# EasyEDA Pro project Zero_PCB_JLCEDA.eprj, board Zero_PCB (continued)
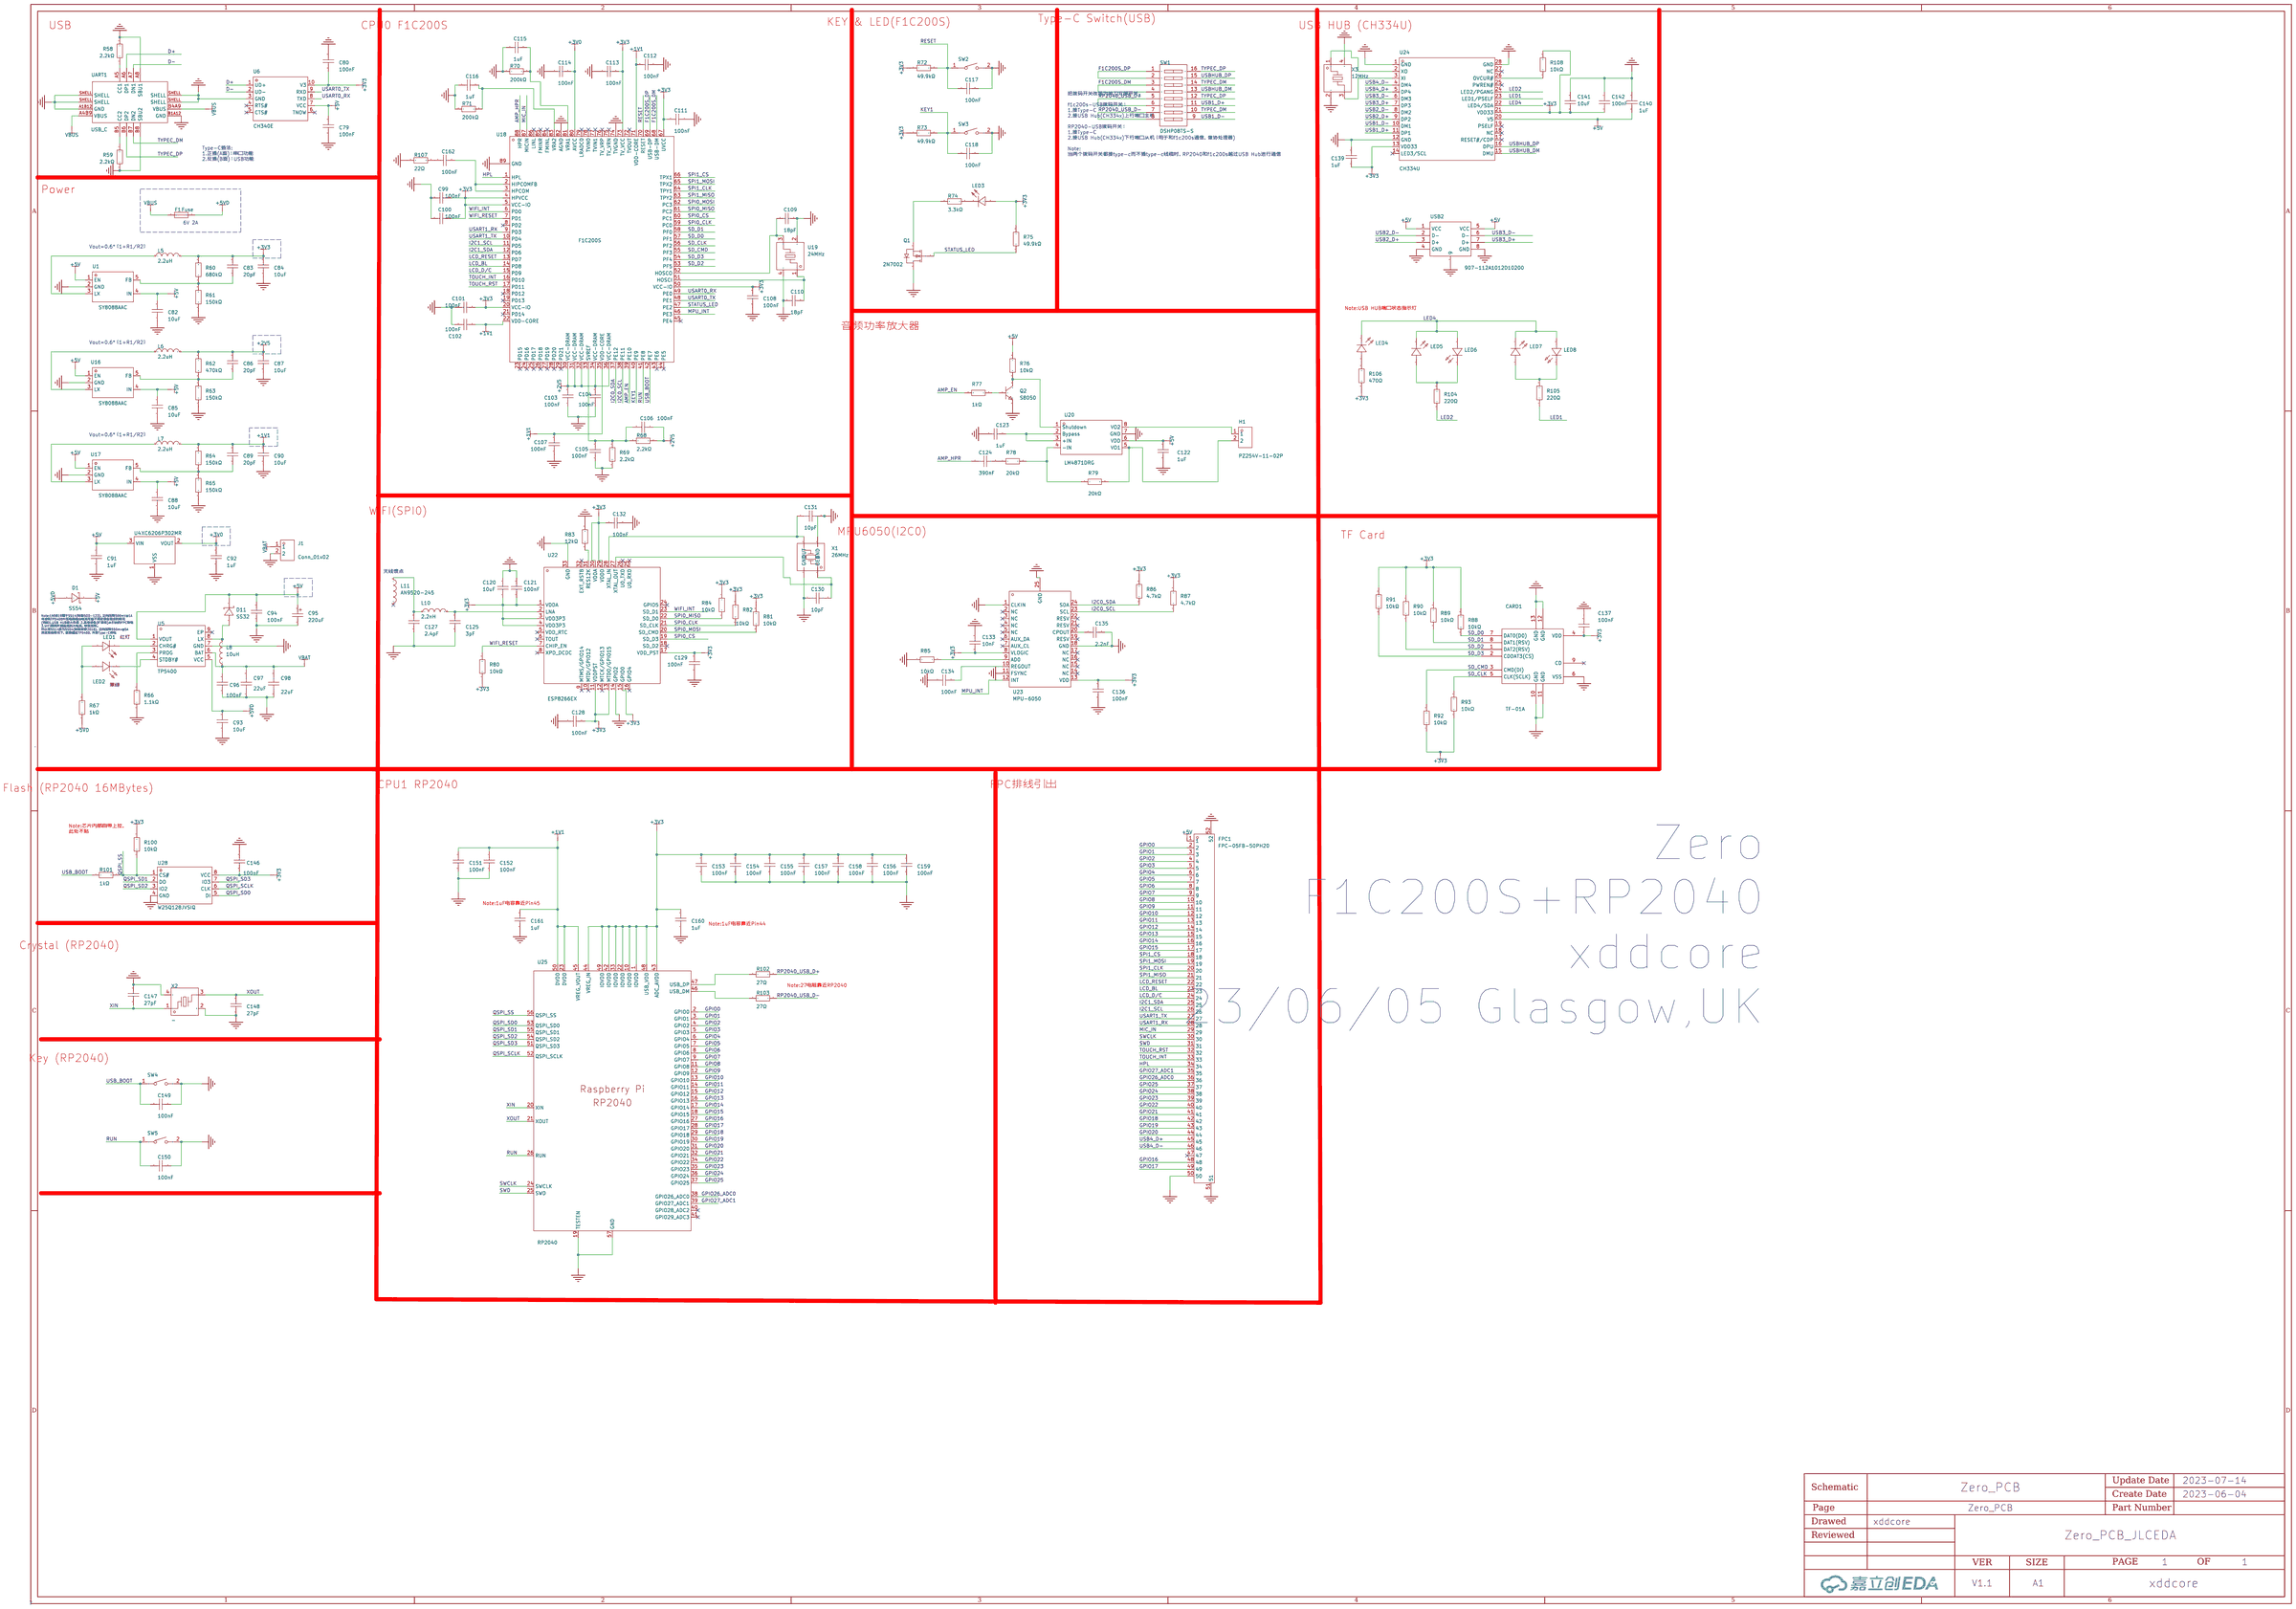
[diagram p0: schematic sheet]
## Routing (per net, layer and track width the routed paths; a pad name or vN(x,y) marks a point on that pad's centre or on a via; arc(x,y) is an arc through that point) (continued)
  Top Layer w0.254: 1.4,35.15 1.66,35.41 2.12,35.41 ; 1.4,35.15 1.4,36 1.43,36.02 1.43,36.24 1.25,36.42 ; 1.4,35.15 1.29,35.04 1.29,32.06 v1(1.81,31.54) 1.82,31.52 2.93,32.63 2.93,34.23 ; 7.24,36.89 7.25,36.9 7.25,37.38 ; C158.1 v1(11.36,23.64) ; v1(18.18,21.98) 18.18,21.98 18.15,21.96 ; 40.39,20.01 40.87,20.5 40.87,21.77 ; 42.11,35.07 42.11,36.38 42.17,36.44 ; 42.11,35.07 42.16,35.03 43.28,35.03 ; 42.11,35.07 42.11,35.03 ; 42.11,35.07 42.1,35.08 ; 6.67,31.73 6.65,31.75 4.1,31.75 ; 3.97,20.14 3.96,20.15 3.59,20.15 ; 18.98,19.54 19.55,18.96 19.55,17.46 19.22,17.12 18.93,17.12 ; 18.98,19.54 18.98,19.52 ; 18.98,19.54 18.91,19.6 ; 18.98,19.54 18.98,19.63 ; 11.35,21.11 9.72,21.11 9.7,21.1 ; 11.35,21.11 11.37,21.11 ; 11.35,21.11 12.22,21.98 v1(13.98,21.98) ; 11.35,21.11 11.34,21.11 ; v1(5.99,26.27) 5.99,27.26 U25.22 ; v1(28.46,43.93) 28.46,43.15 ; 5.61,20.14 5.61,18.81 6.07,18.34 ; 5.61,20.14 5.61,20.27 ; 5.61,20.14 5.59,20.14 ; 5.61,20.14 5.97,20.14 ; 16.37,6.67 17.23,6.67 17.25,6.65 ; 5.42,39.21 5.42,39.22 4.94,39.22 ; 47.47,30.04 47.09,29.65 46.49,29.65 ; 18.15,21.96 18.98,21.13 18.98,19.63 ; 18.15,21.96 17.76,22.35 L5.2 ; 3.57,20.2 2.66,21.11 2.66,21.11 ; 3.57,18.38 3.59,18.4 3.59,20.15 ; 4.94,39.22 4.94,39.15 ; 4.94,39.22 4.92,39.22 ; 4.94,39.22 v1(4.94,39.97) 4.94,40.32 5.12,40.5 ; 3.59,20.15 3.59,20.18 ; 3.59,20.15 3.58,20.15 ; 2.64,24.72 v1(1.7,24.72) 1.16,24.72 ; 48.89,40.59 47.51,40.59 47.49,40.6 ; 7.31,18.36 6.07,18.36 ; 43.6,28.94 v1(43.6,28.11) 43.14,27.65 ; v1(49.15,44.09) 49.46,43.78 49.46,41.24 48.84,40.62 ; 5.29,28.98 5.99,28.27 5.99,27.33 ; v1(15.19,9.42) 14.9,9.14 14.9,7.09 15.42,6.57 16.32,6.57 ; C101.1 26.62,38.14 26.62,40.04 C100.2 ; 47.68,30.1 47.68,30.72 v1(47.42,30.98) ; 47.62,30.05 48.11,30.05 48.5,29.66 48.5,25.83 47.99,25.31 ; U28.8 4.27,11.7 4.31,11.7 ; 18.98,19.63 18.97,19.64 v1(17.96,19.64) ; 18.98,19.63 19,19.61 ; 40.86,45.9 40.46,46.3 C111.2 ; 40.86,45.9 R72.1 ; 40.86,45.9 40.86,45.88 v1(40.52,45.53) ; 2.66,21.11 1.11,21.11 ; 1.11,21.11 C154.1 ; 1.11,21.11 1.54,20.68 1.54,12.53 C146.1 ; 1.11,21.11 1.09,21.11 ; C154.1 1.7,21.73 1.7,24.13 C155.1 ; C154.1 1.08,21.14 ; 2.22,11.81 2.32,11.71 4.31,11.7 ; v2(29.7,18.61) 31.2,18.61 31.2,18.61 ; 7.35,37.39 v1(8.02,37.39) 8.62,37.39 8.96,37.74 ; 13.29,12.59 13.29,13.2 v1(13,13.49) ; 37.7,27.01 37.7,26.96 ; 37.7,27.01 37.7,28.04 ; 37.7,27.01 37.72,25.8 39.95,23.57 40.34,23.57 40.87,23.04 40.87,22.32 ; 28.48,43.13 28.46,43.15 28.5,41.94 28.53,41.91 ; 1.25,36.42 2.13,36.42 ; 1.25,36.42 0.84,36.83 1.1,37.09 1.1,40.4 2.14,41.45 R80.1 2.62,41.42 v1(3.19,41.42) ; 0.94,36.79 1.56,37.4 2.18,37.4 ; 48.92,40.58 48.89,40.56 v1(48.89,39.79) ; 6.88,40.53 6.44,40.09 v1(6.44,39.89) 6.44,39.2 ; 37.7,28.04 v1(37.68,28.06) 35.1,28.06 35.02,28.14 35.02,28.57 34.96,28.64 ; 37.7,28.04 37.7,28.55 37.55,28.7 ; 4.09,31.72 3.72,31.72 2.98,32.45 ; 40.5,19.99 41.23,19.99 v1(41.39,20.14) ; 4.31,11.7 v1(6.49,11.7) ; 11.36,24.73 9.74,24.73
  In2.Cu w0.254: 29.95,21.23 28.87,21.23 17.51,9.87 16.44,9.87 16,9.42 15.19,9.42 ; 29.95,21.23 40.3,21.23 v1(41.39,20.14) ; 29.95,21.23 v2(29.95,20.75) ; v1(5.61,19.3) 8.84,19.3 v1(9.29,19.75) 9.29,20.06 9.98,20.75 12.74,20.75 v1(13.98,21.98) ; v1(6.49,11.7) 7.89,11.7 8.4,12.21 11.72,12.21 v1(13,13.49) 13,13.48 13.24,13.24 13.24,11.05 14.87,9.42 15.19,9.42 ; v1(11.36,23.64) 8.98,23.64 8.73,23.89 8.37,23.89 v1(5.99,26.27) ; v1(28.46,43.93) 28.48,43.95 28.48,45.22 29.28,46.03 32.83,46.03 33.08,45.77 34.73,45.77 36.71,47.75 40.18,47.75 v1(42.37,45.56) 48.38,45.56 v1(49.15,46.34) ; v1(8.02,37.39) 8.02,38.32 v1(6.44,39.89) 6.36,39.97 v1(4.94,39.97) 4.63,39.97 v1(3.19,41.42)
  Bottom Layer w0.127: v1(36.99,45.38) 36.97,45.38 37.28,45.07 39.65,45.07 39.65,44.94 40.35,44.23 41.69,44.23 42.37,44.91 42.37,45.56 v1(42.37,45.56)
  Bottom Layer w0.254: 8.92,18.67 9.17,18.92 9.17,19.47 9.29,19.59 v1(9.29,19.75) ; 47.26,35.29 47.26,31.47 47.24,31.46 47.24,31.16 v1(47.42,30.98) 47.42,28.74 46.8,28.13 43.6,28.13 43.6,28.11 ; 47.26,35.29 48.88,36.91 48.88,39.78 v1(48.89,39.79) ; 47.26,35.29 v1(43.98,35.29) ; 17.48,18.63 16.19,18.63 ; 16.19,18.63 16.18,18.62 ; 16.19,18.63 16.16,18.66 14.21,18.66 ; 16.19,18.63 16.2,18.62 ; 1.8,31.58 1.81,31.57 v1(1.81,31.54) 1.14,30.87 1.14,27.36 1.7,26.8 v1(1.7,24.72) ; v1(42.37,45.56) 40.55,45.56 v1(40.52,45.53) ; 11.7,18.61 11.68,18.62 10.3,18.62 ; v2(29.95,20.75) 29.95,18.86 v2(29.7,18.61) ; 12.89,17.89 12.19,18.6 11.72,18.6 ; v1(43.6,28.11) 43.56,28.07 37.71,28.07 37.7,28.06 v1(37.68,28.06) ; 14.17,18.6 13.76,18.6 13.18,18.02 12.91,18.02 ; 17.49,18.63 17.49,19.17 v1(17.96,19.64) ; 12.61,15.97 12.61,17.52 12.91,17.82 ; v1(18.18,21.98) v1(13.98,21.98) 12.75,21.98 11.36,23.38 v1(11.36,23.64) ; 5.62,19.31 5.61,19.3 v1(5.61,19.3) ; v1(49.15,44.09) v1(49.15,46.34) ; v1(13,13.49) 12.65,13.84 12.65,15.72
+5V: length 53.6
  Top Layer w0.127: v1(20.51,24.71) 21.13,24.09 21.53,24.09 21.94,23.68 v1(21.94,23.6)
  Top Layer w0.254: 17.68,14.75 17.74,14.81 ; 17.68,14.75 17.68,14.61 18.15,14.14 19.9,14.14 21.05,15.29 ; 17.68,14.75 17.64,14.7 16.37,14.7 ; 17.68,14.75 17.68,14.87 ; 24.16,11.36 24.16,11.56 23.53,12.19 ; v1(23.87,42.46) 24.09,42.46 24.58,41.97 ; 18.75,7.27 18.75,7.53 17.91,8.36 ; v1(21.94,23.6) 22.78,23.6 23.88,24.69 ; v1(17.09,8.61) 17.77,8.61 17.86,8.52 ; v1(20.51,24.71) 19.58,24.71 ; 23.05,30.92 23.05,32.35 ; 23.05,32.35 23.03,32.33 ; 23.05,32.35 23.05,34.36 ; 27.9,27.56 26.87,27.56 v1(26.08,28.35) 25.18,29.26 25.18,29.44 ; 38.33,26.97 38.33,28.18 38.81,28.66 ; 19.74,23.58 19.74,24.51 19.52,24.74 ; 21.12,17.35 21.17,17.3 21.17,15.46 ; 22.97,34.39 23.04,34.46 23.04,36.6 24.88,38.44 24.88,41.22 24.61,41.48 24.61,41.93 ; 23.5,12.44 23.5,13.13 v1(22.8,13.83) 21.17,15.46 ; 21.17,15.46 21.17,15.07 ; 21.17,15.46 20.97,15.66 ; 15.43,18.19 15.43,17.4 15.17,17.14 ; 17.37,21.11 17.37,20.62 v1(16.44,19.69) 15.51,18.76 15.51,18.5 ; 23.94,29.97 24.61,29.97 25.16,29.42 ; v1(19.6,26.21) 20.04,26.65 21.3,26.65 21.48,26.82 21.48,27.38 ; 23.8,30.21 23.09,30.92 ; 38.97,28.66 v1(38.97,29.45)
  Bottom Layer w0.254: v1(19.6,26.21) 19.6,25.62 v1(20.51,24.71) ; 28.58,31.2 29.05,31.2 v1(29.25,30.99)
+5VD: length 25.6
  Top Layer w0.254: 27.3,19.61 27.37,19.54 27.37,18.31 ; 30.74,9.98 31.18,9.98 v1(31.3,10.1) ; 18.27,13 21.09,10.17 ; 27.37,18.31 28.14,18.31 v1(28.31,18.13) ; 27.37,18.31 27.37,18.13 ; 27.37,18.31 27.31,18.31 ; 21.13,10.5 v1(21.13,11.93)
  In2.Cu w0.254: v1(21.13,11.93) 27.16,11.93 28.31,13.09 ; v1(28.31,18.13) 28.31,13.09 ; 28.31,13.09 v1(31.3,10.1)
GND: length 254.5
  Top Layer w0.254: 16.27,7.65 15.67,8.25 v1(15.67,8.72) ; 45.43,31.93 45.64,32.15 46.35,32.15 ; 43,26.41 42.19,27.22 42.19,27.77 41.27,28.69 40,28.69 ; 39.37,47.36 36.96,47.36 36.9,47.41 ; 28.28,8.12 28.23,8.07 ; 28.28,8.12 28.53,8.37 28.53,9.88 ; 28.28,8.12 28.22,8.12 ; 28.28,8.12 28.76,8.12 29.28,7.6 ; v1(23.96,36.22) 24.27,35.91 24.31,35.91 ; 44.9,36.38 44.71,36.19 44.71,34.51 ; 44.9,36.38 44.94,36.42 ; 44.9,36.38 44.89,36.39 43.26,36.39 ; 22.83,28.86 23.1,28.59 v1(23.1,28.14) 23.1,27.41 ; 7.77,30.04 7.74,30.01 4,30.01 ; 7.77,30.04 7.79,30.06 ; 7.77,30.04 9.05,30.04 9.59,30.57 ; UART1.A8 26.28,8.8 25.54,9.54 25.54,9.87 R66.1 ; 33.52,15.41 35.23,17.13 35.23,18.15 35.24,18.16 ; 23.28,9.86 23.29,9.85 23.29,8.09 ; 34.17,12.11 34.15,12.13 34.11,12.13 ; 20.57,27.46 v1(20.57,28.27) 20.57,28.49 20.16,28.89 ; 33.75,28.65 33.28,28.18 33.28,27.25 ; 14.06,15.65 14.06,15.63 ; 14.06,15.63 11.31,15.63 ; 14.06,15.63 14.06,15.63 ; 16.31,17.16 17.22,16.25 17.66,16.25 ; 2.8,31.34 2.9,31.24 ; 2.9,31.24 C129.1 ; 2.9,31.24 4,30.14 4,30.08 ; 2.9,31.24 v1(2.9,30.49) ; 26.18,44.85 27.69,44.85 27.83,44.72 27.83,43.59 C99.1 ; 26.18,44.85 26.18,46.18 26.69,46.7 27.45,46.7 ; 26.18,44.85 26.16,44.85 24.68,43.37 24.45,43.37 ; 41.15,48.01 41.6,48.47 43.42,48.47 ; 17.61,16.24 18.75,15.1 18.75,14.82 ; v1(21.46,23.19) 21.08,23.57 20.88,23.57 ; 36.27,31.53 37.47,31.53 37.49,31.55 ; v1(38.18,31.53) 38.01,31.37 37.56,31.37 ; 27.39,21.04 26.82,21.61 25.54,21.61 24.99,21.06 ; 43.23,36.39 43.23,38.75 43.17,38.8 ; 27.43,43.13 27.43,41.88 ; 36.88,47.37 34.38,47.37 34.37,47.36 ; 11.36,25.81 12.08,25.09 v1(12.08,23.44) 12.08,23 11.34,22.26 C156.2 ; 16.45,21.02 16.45,20.53 15.95,20.03 13.93,20.03 v1(13.92,20.02) ; 11.44,29.17 11.44,26.04 11.32,25.92 ; 17.64,29.56 17.64,30.19 15.9,31.92 ; 33.21,47.02 32.84,47.39 30.96,47.39 30.65,47.08 ; 36.59,44.54 36.59,42.32 36.55,42.28 ; 47.53,27.61 47.66,27.74 47.66,28.83 ; 27.4,36.22 27.42,36.24 ; 27.4,36.22 27.4,34.94 ; 27.4,36.22 27.4,36.6 ; 46.7,38.65 46.7,38.46 45.14,36.91 ; U6.3 18.25,3.65 v1(18.3,3.7) ; 3.53,17.28 v1(2.75,17.28) ; v1(17.36,19.78) 16.28,18.7 16.28,17.09 ; 28.05,28.43 28.25,28.43 28.73,27.95 28.73,27.75 28.98,27.5 28.98,27.31 ; v1(16.85,12.32) 16.78,12.4 16.04,12.4 ; 27.5,20.8 28.84,20.8 30.06,19.58 33.22,19.58 33.29,19.65 ; 24.31,35.91 25.59,37.2 26.79,37.2 27.39,36.6 ; 24.31,35.91 24.31,34.69 ; 39.32,47.4 40.02,48.09 41.22,48.09 ; C121.2 v1(7.92,41.54) ; 17.46,26.07 17.54,26.15 17.54,29.47 ; 23.01,43.06 24.11,43.06 24.37,43.32 ; 43.42,48.47 43.4,48.48 ; 43.42,48.47 43.43,48.47 ; 43.42,48.47 43.46,48.42 v1(45.13,48.42) 48.91,48.42 49.17,48.17 ; 45.1,28.94 45.1,29.87 45.08,29.89 ; 4.02,40.51 4.02,41.01 4.78,41.77 ; 3.55,17.27 8.56,17.27 8.6,17.23 ; 3.11,35.87 3.09,35.9 2.07,35.9 ; v1(18.48,22.84) 18.9,22.42 18.9,22.26 ; 19.13,8.5 19.76,8.5 20.75,7.51 ; 9.81,39.15 9.36,39.6 8.86,39.6 7.87,40.58 ; 13.52,36.91 11.79,35.18 ; 30.65,47.08 30.36,47.37 v2(29.59,47.37) 29.58,47.36 28.11,47.36 27.45,46.7 ; 30.65,47.08 30.6,47.03 ; 1.09,25.91 v1(1.09,26.75) ; 27.45,46.7 27.52,46.7 ; 33.33,42.28 33.39,42.34 33.39,44.55 ; 44.46,26.63 44.27,26.43 43.09,26.43 ; v1(0.83,34.43) 0.83,35.66 C128.1 ; 33.27,26.67 33.21,26.67 v1(32.16,25.62) 30.41,23.87 29.86,23.87 ; 1.05,25.78 0.98,25.78 0.53,25.33 0.53,22.95 1.11,22.37 ; v1(47.94,38.67) 47.89,38.72 46.67,38.72 ; SW5.2 17.49,26.05 v1(16.4,26.05) ; 9.73,39.02 10.1,38.65 10.1,37.72 ; 7.2,27.34 7.2,24.83 7.12,24.74 ; 29.21,6.78 28.61,6.18 26.84,6.18 26.26,6.76 26.26,7.88 ; 17.49,25.95 17.49,25.23 15.95,23.69 ; 36.4,28.68 37.06,29.34 38.15,29.34 38.9,30.09 39.56,30.09 40.02,29.64 40.02,28.71 ; 8.99,36.52 10.05,37.58 10.05,37.71 ; 40.25,21.21 40.25,21.02 39.28,20.05 ; 32.68,31.51 31.97,30.81 v1(30.24,30.81) ; 32.68,31.51 32.66,31.53 ; 32.68,31.51 32.95,31.24 32.95,30.14 ; 32.68,31.51 32.74,31.58 ; 13.53,37.3 v1(13.53,38.5) ; 42.75,21.49 43.16,21.89 v1(44.17,21.89) 45.95,21.89 ; 14.47,15.63 14.86,15.63 16.25,17.02 ; 21.85,8.06 21.11,7.32 20.72,7.32 ; 24.04,28.72 23.84,28.92 22.77,28.92 ; 27.41,43.16 27.43,43.13 ; 2.32,13.01 2.38,13.01 2.85,13.48 2.84,13.5 v1(2.84,13.59) ; 33.2,47.04 34.14,47.04 34.44,47.34 ; 43.22,31.97 43.03,32.16 42.39,32.16 ; 9.76,39.14 9.77,39.14 ; 11.68,35.25 11.63,35.3 10.11,35.3 ; 9.99,30.46 9.49,30.46 ; v1(26.5,28.85) 27.39,28.85 27.76,28.49 ; 24.87,18.14 24.93,18.2 24.93,20.79 ; 20.84,6.7 21.48,6.05 22.94,6.05 23.29,6.4 23.29,7.93 ; 24.27,34.42 24.27,32.28 ; 33.25,20.22 33.25,21.76 ; 32.69,31.52 33.82,31.52 ; 43.22,41.59 v1(44.21,41.59) ; 23.34,11.14 23.34,9.87
  Top Layer w0.349: C125.1 4.07,41.79 v1(3.95,41.67) ; 4.83,45.08 4.83,41.81
  In1.Cu w0.254: 36.57,12 36.47,12.09 34.07,12.09 ; v1(18.3,3.7) 20.16,3.7 UART1.SHELL UART1.SHELL ; 34.07,12.15 34.07,14.91 33.81,15.17 ; UART1.SHELL UART1.SHELL ; 36.79,11.98 39.55,14.74 39.55,15.17
  Bottom Layer w0.254: 4.52,14.91 3.2,13.59 v1(2.84,13.59) ; 14.9,15.88 14.9,14.64 ; 14.9,14.64 14.9,14.06 15.64,13.31 18.29,13.31 19.17,14.2 19.17,15.17 ; 14.9,14.64 14.13,14.64 v1(14.08,14.68) ; 12.84,18.91 13.92,19.99 v1(13.92,20.02) ; v1(2.9,30.49) 3.34,30.49 4.07,31.22
  vias: v1(0.56,42.53) v1(0.56,42.14) v1(0.94,42.53) v1(0.94,42.14) v1(1.3,42.53) v1(1.3,42.14) v1(1.68,42.53) v1(1.68,42.14) v1(2.06,42.54) v1(2.06,42.15) v1(2.44,42.54) v1(2.44,42.15) v1(2.82,42.55) v1(2.82,42.17) v1(3.2,42.55) v1(3.2,42.17) v1(3.58,42.55) v1(3.58,42.17) v1(3.96,42.55) v1(3.96,42.17) v1(4.12,37.12) v1(4.12,36.74) v1(4.12,36.36) v1(4.12,35.98) v1(4.5,37.12) v1(4.5,36.74) v1(4.51,36.36) v1(4.51,35.98) v1(4.88,37.12) v1(4.88,36.74) v1(4.89,36.36) v1(4.89,35.98) v1(5.27,37.12) v1(5.27,36.74) v1(5.27,36.36) v1(5.27,35.98) v1(5.64,24.19) v1(5.64,23.81) v1(5.64,23.43) v1(5.64,23.05) v1(6.02,24.19) v1(6.02,23.81) v1(6.02,23.43) v1(6.02,23.05) v1(6.4,24.19) v1(6.4,23.81) v1(6.4,23.43) v1(6.4,23.05) v1(6.76,42.31) v1(6.76,41.92) v1(6.78,24.19) v1(6.78,23.81) v1(6.78,23.43) v1(6.78,23.05) v1(7.15,42.31) v1(7.15,41.92) v1(7.54,42.31) v1(7.54,41.92) v1(7.92,42.31) v1(7.92,41.92) v1(8.3,42.31) v1(8.3,41.93) v1(8.68,42.31) v1(8.68,41.93) v1(9.07,42.31) v1(9.07,41.92) v1(9.45,42.31) v1(9.45,41.92) v1(9.84,44.11) v1(9.84,43.73) v1(9.84,43.35) v1(9.84,42.97) v1(9.84,42.58) v1(9.84,42.2) v1(9.84,41.82) v1(10.22,44.11) v1(10.22,43.73) v1(10.22,43.35) v1(10.22,42.97) v1(10.22,42.58) v1(10.22,42.2) v1(10.22,41.82) v1(10.62,44.13) v1(10.62,43.75) v1(11,44.13) v1(11,43.75) v1(11.38,44.13) v1(11.38,43.75) v1(11.76,44.13) v1(11.76,43.75) v1(12.15,44.13) v1(12.15,43.75) v1(12.53,44.13) v1(12.53,43.75) v1(12.91,44.13) v1(12.91,43.75) v1(13.29,44.13) v1(13.29,43.75) v1(13.67,44.12) v1(13.67,43.73) v1(14.05,44.12) v1(14.05,43.73) v1(14.44,44.12) v1(14.44,43.74) v1(14.82,44.12) v1(14.82,43.74) v1(15.23,44.13) v1(15.23,43.75) v1(15.61,44.13) v1(15.61,43.75) v1(16,44.13) v1(16,43.75) v1(16.38,44.13) v1(16.38,43.75) v1(16.76,44.13) v1(16.76,43.75) v1(17.14,44.13) v1(17.14,43.75) v1(17.52,44.13) v1(17.52,43.75) v1(17.9,44.13) v1(17.9,43.75) v1(18.29,44.12) v1(18.29,43.73) v1(18.67,44.12) v1(18.67,43.73) v1(19.05,44.12) v1(19.05,43.74) v1(19.43,44.12) v1(19.43,43.74) v1(19.82,49.33) v1(19.82,48.94) v1(19.83,48.56) v1(19.83,48.18) v1(19.82,47.8) v1(19.82,47.42) v1(19.83,47.04) v1(19.83,46.65) v1(19.81,46.27) v1(19.81,45.89) v1(19.82,45.51) v1(19.82,45.13) v1(19.82,44.74) v1(19.82,44.36) v1(19.82,43.97) v1(19.82,43.59) v1(20.2,49.33) v1(20.2,48.94) v1(20.21,48.56) v1(20.21,48.18) v1(20.2,47.8) v1(20.2,47.42) v1(20.21,47.04) v1(20.21,46.65) v1(20.2,46.27) v1(20.2,45.89) v1(20.2,45.51) v1(20.2,45.13) v1(20.2,44.74) v1(20.2,44.36) v1(20.2,43.97) v1(20.2,43.59) v1(33.24,20.56) v1(34.04,40.68) v1(34.04,40.3) v1(34.04,39.92) v1(34.04,39.54) v1(34.04,39.16) v1(34.04,38.78) v1(34.04,38.39) v1(34.42,40.68) v1(34.42,40.3) v1(34.42,39.92) v1(34.42,39.54) v1(34.42,39.16) v1(34.42,38.78) v1(34.42,38.39) v1(34.8,40.68) v1(34.8,40.3) v1(34.8,39.92) v1(34.8,39.54) v1(34.8,39.16) v1(34.8,38.78) v1(34.8,38.4) v1(35.18,40.68) v1(35.18,40.3) v1(35.18,39.92) v1(35.18,39.54) v1(35.18,39.16) v1(35.18,38.78) v1(35.18,38.4) v1(35.56,40.68) v1(35.56,40.3) v1(35.56,39.92) v1(35.56,39.54) v1(35.56,39.16) v1(35.57,38.78) v1(35.57,38.4) v1(35.94,40.69) v1(35.94,40.31) v1(35.94,39.92) v1(35.94,39.54) v1(35.94,39.16) v1(35.95,38.78) v1(35.95,38.4) v1(36.33,40.69) v1(36.33,40.31) v1(36.33,39.92) v1(36.33,39.54) v1(36.33,39.16) v1(36.33,38.78) v1(36.33,38.4) v1(43.76,26.44) v1(43.82,31.52) v1(43.82,31.14) v1(43.82,30.76) v1(43.82,30.38) v1(44.2,31.52) v1(44.2,31.14) v1(44.2,30.76) v1(44.2,30.38) v1(44.58,31.52) v1(44.58,31.14) v1(44.58,30.76) v1(44.58,30.38) v1(44.96,31.52) v1(44.96,31.14) v1(44.96,30.76) v1(44.96,30.38) v1(47.66,28.17) v2(0.45,41.72) v2(0.45,41.17) v2(0.45,40.61) v2(0.45,40.06) v2(0.45,39.56) v2(0.45,39.01) v2(0.45,38.46) v2(0.45,37.91) v2(0.46,34.07) v2(0.46,33.52) v2(0.46,33.02) v2(0.46,32.47) v2(0.46,31.91) v2(0.46,31.36) v2(0.46,30.9) v2(0.46,30.35) v2(0.46,29.8) v2(0.46,29.25) v2(0.46,28.75) v2(0.46,28.2) v2(0.46,27.64) v2(0.46,27.09) v2(0.46,26.59) v2(0.46,26.04) v2(0.46,22.24) v2(0.46,21.69) v2(0.46,21.14) v2(0.46,20.59) v2(0.46,20.08) v2(0.46,19.53) v2(0.46,18.98) v2(0.46,18.43) v2(0.45,17.8) v2(0.45,17.25) v2(0.45,16.7) v2(0.45,13.53) v2(0.45,12.98) v2(0.45,12.43) v2(0.45,11.88) v2(0.45,11.38) v2(0.45,10.83) v2(0.45,10.28) v2(0.45,9.73) v2(0.45,9.22) v2(0.45,8.67) v2(0.45,8.12) v2(0.45,7.57) v2(0.45,7.06) v2(0.45,6.51) v2(0.45,5.96) v2(0.45,5.41) v2(0.45,4.87) v2(0.45,4.32) v2(0.45,3.77) v2(0.45,3.22) v2(0.45,2.72) v2(0.45,2.17) v2(0.45,1.61) v2(0.45,1.06) v2(0.79,0.41) v2(1.34,0.41) v2(1.89,0.41) v2(2.43,0.41) v2(3.53,0.41) v2(5.13,0.41) v2(6.24,0.41) v2(7.3,0.41) v2(7.85,0.41) v2(8.9,0.41) v2(10,0.41) v2(11.56,0.41) v2(12.67,0.41) v2(13.17,0.41) v2(13.72,0.41) v2(14.27,0.41) v2(14.82,0.41) v2(15.31,0.41) v2(15.86,0.41) v2(16.41,0.41) v2(16.96,0.41) v2(17.46,0.41) v2(18.05,0.4) v2(18.53,0.4) v2(19.08,0.4) v2(19.64,0.4) v2(20.19,0.4) v2(20.71,49.18) v2(20.69,0.4) v2(21.25,49.18) v2(21.22,0.4) v2(21.71,0.4) v2(21.8,49.18) v2(22.26,0.4) v2(22.81,0.4) v2(23.36,0.4) v2(23.4,49.18) v2(23.86,0.4) v2(24.39,0.4) v2(24.95,0.43) v2(25.5,0.43) v2(26.05,0.43) v2(26.55,0.43) v2(26.62,49.18) v2(27.12,49.18) v2(27.1,0.43) v2(27.65,0.43) v2(27.67,49.18) v2(28.23,49.18) v2(28.2,0.43) v2(28.67,0.43) v2(28.77,49.18) v2(29.22,0.43) v2(29.28,49.18) v2(29.77,0.43) v2(29.83,49.18) v2(30.32,0.43) v2(30.39,49.18) v2(30.82,0.43) v2(30.94,49.18) v2(31.37,0.43) v2(31.44,49.18) v2(31.92,0.43) v2(31.99,49.18) v2(32.54,49.18) v2(32.47,0.43) v2(33.09,49.18) v2(33.63,49.18) v2(34.18,49.18) v2(34.73,49.18) v2(35,0.4) v2(35.28,49.18) v2(35.56,0.4) v2(35.83,49.16) v2(36.11,0.4) v2(36.38,49.16) v2(36.65,0.4) v2(36.93,49.16) v2(37.2,0.4) v2(37.44,49.18) v2(37.75,0.4) v2(37.93,49.18) v2(38.3,0.4) v2(38.48,49.18) v2(39.03,49.18) v2(39.58,49.18) v2(40.09,49.18) v2(40.64,49.18) v2(40.96,0.4) v2(41.19,49.18) v2(41.51,0.4) v2(41.74,49.18) v2(42.07,0.4) v2(42.2,49.18) v2(42.62,0.4) v2(43.12,0.4) v2(43.67,0.4) v2(44.22,0.4) v2(44.77,0.4) v2(44.91,49.18) v2(45.23,0.4) v2(45.46,49.18) v2(45.78,0.4) v2(46.34,0.4) v2(46.88,0.4) v2(47.39,0.4) v2(47.94,0.4) v2(48.17,49.18) v2(48.49,0.4) v2(48.67,49.18) v2(49.04,0.4) v2(49.22,49.18) v2(49.52,40.06) v2(49.52,39.51) v2(49.52,38.96) v2(49.52,38.46) v2(49.52,37.91) v2(49.52,37.36) v2(49.52,36.81) v2(49.52,36.34) v2(49.52,35.79) v2(49.52,35.24) v2(49.52,34.69) v2(49.52,34.19) v2(49.52,33.64) v2(49.52,33.09) v2(49.52,32.54) v2(49.52,32.03) v2(49.52,31.48) v2(49.52,30.92) v2(49.52,30.38) v2(49.52,29.87) v2(49.52,29.32) v2(49.52,28.77) v2(49.52,28.22) v2(49.52,27.68) v2(49.52,27.13) v2(49.52,26.58) v2(49.52,26.03) v2(49.52,25.52) v2(49.52,24.97) v2(49.52,24.42) v2(49.52,23.87) v2(49.52,23.41) v2(49.52,22.86) v2(49.52,22.31) v2(49.52,21.76) v2(49.52,21.25) v2(49.52,20.7) v2(49.52,20.15) v2(49.52,19.6) v2(49.52,19.14) v2(49.52,18.59) v2(49.52,18.04) v2(49.52,17.49) v2(49.52,16.98) v2(49.52,16.44) v2(49.52,15.88) v2(49.52,15.33) v2(49.52,14.82) v2(49.52,14.28) v2(49.52,13.72) v2(49.52,13.17) v2(49.52,12.67) v2(49.52,12.12) v2(49.52,11.57) v2(49.52,11.02) v2(49.52,10.48) v2(49.52,9.93) v2(49.52,9.37) v2(49.52,8.83) v2(49.52,8.32) v2(49.52,7.77) v2(49.52,7.22) v2(49.52,6.67) v2(49.52,6.13) v2(49.52,5.58) v2(49.52,5.03) v2(49.52,4.48) v2(49.52,3.97) v2(49.52,3.42) v2(49.52,2.87) v2(49.52,2.32) v2(49.52,1.86) v2(49.52,1.31) v2(49.52,0.76)
VBAT: length 34
  Top Layer w0.254: 25.69,17.13 26.06,17.5 ; 25.69,17.13 26.6,17.13 v2(26.61,17.14) ; 25.69,17.13 24.42,17.13 24.13,17.41 24.13,19.19 23.83,19.5 ; 46.19,19.7 43.46,19.7 42.73,20.44 ; 26.01,20.79 26.05,20.74 26.05,17.5
  In2.Cu w0.254: v2(26.61,17.14) 29.23,19.76 35.3,19.76 36.36,20.82 40,20.82 41.43,19.39 45.99,19.39 46.04,19.44
VBUS: length 15.6
  Top Layer w0.254: F1.2 17.46,9.41 v1(16.65,9.41) ; UART1.A4B9 22.62,8.08 v1(22.62,9.16) ; v1(27.83,9.16) 27.43,8.76 UART1.B4A9
  Bottom Layer w0.254: v1(16.65,9.41) 16.91,9.16 v1(22.62,9.16) v1(27.83,9.16)
AMP_EN: length 28
  Top Layer w0.127: v1(23.85,44.32) 23.69,44.48 23.02,44.48 ; 37.38,34.5 37.38,35.01 36.45,35.95 31.72,35.95 31.45,36.22 31.45,38.09 v1(31.22,38.32)
  Bottom Layer w0.127: v1(31.22,38.32) 30.81,38.73 28.49,38.73 27.33,37.56 27.33,35.65 27.05,35.38 25.81,35.38 25.38,35.8 25.22,35.8 25.14,35.88 25.14,43.03 v1(23.85,44.32)
AMP_HPR: length 11.5
  Top Layer w0.127: 31,44.52 v1(31,45.34) ; v1(21.02,45.34) 21.67,45.34 21.67,45.35
  Bottom Layer w0.127: v1(21.02,45.34) v1(31,45.34)
D+: length 15.3
  Top Layer w0.127: UART1.A6 24.78,1.54 24.53,1.28 v1(18.3,1.28) ; U6.1 17.29,2.44 v1(17.29,1.28)
  Bottom Layer w0.127: v1(18.3,1.28) v1(17.29,1.28)
D-: length 15.7
  Top Layer w0.127: UART1.A7 25.28,1.66 24.52,0.89 17.93,0.89 17.75,1.07 U6.2
F1C200S_DM: length 72.5
  Top Layer w0.127: U18.68 38.97,44.53 38.97,43.73 v1(39.11,43.59) ; v1(6.92,3.19) SW1.4 SW1.3
  In1.Cu w0.127: v1(6.92,3.19) 6.92,5.27 34.94,33.29 35.96,33.29 36.21,33.54 36.21,34.56 38.75,37.1 38.75,37.58 39.09,37.91 40.47,37.91 40.59,38.03 45.77,38.03 46.54,38.81 46.54,42.89 45.41,44.02 39.53,44.02 v1(39.11,43.59)
F1C200S_DP: length 72.9
  Top Layer w0.127: v1(38.5,43.58) 38.5,43.94 38.58,44.03 U18.69 ; SW1.1 SW1.2 v1(4.38,3.19)
  In1.Cu w0.127: v1(4.38,3.19) 38.52,37.33 38.52,37.67 38.99,38.14 39.43,38.14 39.74,38.45 40.81,38.45 40.94,38.31 45.59,38.31 46.06,38.79 46.06,42.44 44.71,43.79 39.8,43.79 39.48,43.47 39.48,43.34 39.34,43.2 38.87,43.2 v1(38.5,43.58)
GPIO0: length 26.7
  Top Layer w0.127: 9.36,21.52 8.91,21.52 8.7,21.74 8.7,21.75 v1(8.68,21.75)
  Bottom Layer w0.127: v1(8.68,21.75) 9.37,21.07 21.35,21.07 28.08,27.8 28.08,31.25
GPIO1: length 24.9
  Top Layer w0.127: v1(10.69,21.95) 9.89,21.95 9.87,21.92
  In1.Cu w0.127: v1(27.59,30.09) 27.59,26.72 22.12,21.24 11.32,21.24 10.68,21.88 10.68,21.94 v1(10.69,21.95)
  Bottom Layer w0.127: 27.59,31.25 v1(27.59,30.09)
GPIO2: length 27.2
  Top Layer w0.127: v1(8.18,22.27) 8.22,22.32 9.8,22.32
  In1.Cu w0.127: v1(26.92,29.85) 26.92,26.44 22.83,22.34 18.38,22.34 18.23,22.5 10.65,22.5 10.55,22.4 8.3,22.4 v1(8.18,22.27)
  Bottom Layer w0.127: v1(26.92,29.85) 27.11,30.04 27.14,30.04 27.14,31.25
GPIO3: length 26.7
  Top Layer w0.127: v1(8.29,22.84) 8.39,22.73 9.77,22.73
  In1.Cu w0.127: v1(26.2,29.69) 25.66,29.14 25.66,25.51 22.78,22.63 19.23,22.63 18.8,23.06 18.8,23.17 18.74,23.24 18.1,23.24 17.62,22.76 8.36,22.76 v1(8.29,22.84)
  Bottom Layer w0.127: 26.59,31.14 26.59,30.08 v1(26.2,29.69)
GPIO4: length 22.7
  Top Layer w0.127: v1(10.79,23.17) 10.74,23.12 9.8,23.12
  In1.Cu w0.127: v1(10.79,23.17) 10.92,23.03 17.56,23.03 18.52,23.99 23.76,23.99 25.2,25.43 v1(25.2,28.31)
  Bottom Layer w0.127: 26.13,31.15 26.13,30.44 25.62,29.93 25.62,28.5 25.43,28.31 v1(25.2,28.31)
GPIO5: length 24.6
  Top Layer w0.127: 9.46,23.52 8.93,23.52 v1(8.66,23.25)
  In1.Cu w0.127: v1(24.62,28.62) 24.62,25.5 23.38,24.26 18.44,24.26 17.71,23.54 12.74,23.54 12.25,24.03 11,24.03 10.2,23.23 v1(8.67,23.23)
  Bottom Layer w0.127: v1(8.67,23.23) 8.67,23.24 v1(8.66,23.25) ; 25.53,31.2 25.53,30.36 25.3,30.13 25.3,28.78 25.28,28.76 24.76,28.76 v1(24.62,28.62)
GPIO6: length 24.5
  Top Layer w0.127: v1(8.5,24.5) 8.5,24.09 8.67,23.92 9.79,23.92
  In2.Cu w0.127: v1(8.5,24.5) 8.67,24.32 23.32,24.32 24.08,25.07 v1(24.08,28)
  Bottom Layer w0.127: v1(24.08,28) 24.08,28.7 24.67,29.29 25.02,29.29 25.02,31.19 25.08,31.25
GPIO7: length 24.5
  Top Layer w0.127: v1(8.15,24.86) 8.2,24.91 8.77,24.91 8.77,24.78 8.99,24.56 8.99,24.36 9.04,24.32 9.71,24.32 9.72,24.3
  In1.Cu w0.127: v1(23.42,26.61) 21.54,24.73 21.06,24.73 20.6,25.18 20.38,25.18 19.69,24.49 18.3,24.49 17.59,23.78 17.59,23.77 12.87,23.77 12.27,24.37 9.32,24.37 8.79,24.9 8.18,24.9 v1(8.15,24.86)
  Bottom Layer w0.127: v1(23.42,26.61) 23.64,26.82 23.64,28.66 24.57,29.59 24.57,31.23
GPIO8: length 23
  Top Layer w0.127: 9.52,25.11 9.51,25.12 9.08,25.12 8.9,25.3 v1(8.56,25.3)
  In1.Cu w0.127: v1(22.73,26.66) 22.28,26.21 21.79,26.21 21.6,26.02 21.6,25.22 21.44,25.06 21.18,25.06 20.82,25.43 20.27,25.43 19.59,24.75 18.13,24.75 17.41,24.03 12.96,24.03 12.38,24.6 9.43,24.6 8.71,25.32 8.57,25.32 v1(8.56,25.3)
  Bottom Layer w0.127: v1(22.73,26.66) 22.67,26.73 22.67,28.68 23.38,29.4 23.93,29.4 24.07,29.53 24.07,31.16
GPIO9: length 18.6
  Top Layer w0.127: 10.03,25.53 10.51,25.53 v1(10.72,25.32)
  In1.Cu w0.127: v1(21.1,25.73) 20.11,25.73 19.37,24.99 18.02,24.99 17.32,24.29 13.02,24.29 12.48,24.83 11.21,24.83 v1(10.72,25.32)
  Bottom Layer w0.127: v1(21.1,25.73) 21.1,25.82 21.13,25.86 21.13,25.88 21.78,26.52 21.78,28.22 23.62,30.06 23.62,31.09
GPIO10: length 20.5
  Top Layer w0.127: v1(8.68,26.18) 8.92,25.94 9.49,25.94
  In1.Cu w0.127: v1(8.68,26.18) 8.91,25.94 10.66,25.94 11.46,25.14 13.33,25.14 13.91,24.56 17.16,24.56 v1(19.19,26.59)
  Bottom Layer w0.127: 23.21,31.21 23.21,30.02 21.52,28.32 21.52,26.81 21.37,26.66 19.26,26.66 v1(19.19,26.59)
GPIO11: length 18.2
  Top Layer w0.127: v1(10.73,26.38) 10.68,26.33 10,26.33
  In1.Cu w0.127: v1(18.56,27.15) 18.56,26.29 17.08,24.81 14,24.81 13.42,25.39 11.73,25.39 v1(10.73,26.38)
  Bottom Layer w0.127: 22.56,31.23 22.56,29.69 21.27,28.41 21.27,27.26 20.9,26.89 19.53,26.89 19.44,26.98 18.73,26.98 v1(18.56,27.15)
GPIO12: length 19.4
  Top Layer w0.127: v1(9.43,26.79) 9.24,26.79 8.82,27.21
  In1.Cu w0.127: v1(9.43,26.79) 10.9,26.79 11.15,26.54 11.15,26.31 11.84,25.62 13.54,25.62 14.1,25.05 16.98,25.05 18.08,26.16 v1(18.08,27.38)
  Bottom Layer w0.127: v1(18.08,27.38) 18.11,27.38 18.28,27.55 18.84,27.55 19.17,27.21 19.53,27.21 19.62,27.13 20.77,27.13 21.04,27.39 21.04,28.52 22.06,29.54 22.06,31.14
GPIO13: length 20.6
  Top Layer w0.127: v1(8.06,26.21) 8.4,26.55 8.4,27.01
  In1.Cu w0.127: v1(8.06,26.21) 8.41,26.56 8.58,26.56 9.21,27.19 9.62,27.19 9.77,27.04 10.98,27.04 11.44,26.59 11.44,26.35 11.94,25.85 13.65,25.85 14.21,25.28 16.87,25.28 17.67,26.08 17.67,27.74 17.91,27.97 v1(18.14,27.97)
  Bottom Layer w0.127: 21.57,31.2 21.57,29.4 20.84,28.67 20.37,28.67 20.16,28.47 20.16,28.16 19.79,27.79 18.33,27.79 v1(18.14,27.97) ; v1(8.06,26.21) v1(8.06,26.21)
GPIO14: length 19.4
  Top Layer w0.127: v1(9.43,27.64) 9.03,28.04 8.21,28.04 7.98,27.81
  In1.Cu w0.127: v1(9.43,27.64) 9.5,27.64 9.86,27.29 11.06,27.29 11.67,26.68 11.67,26.45 12,26.11 13.73,26.11 14.31,25.53 16.76,25.53 17.42,26.19 17.42,27.86 v1(18.05,28.49)
  Bottom Layer w0.127: 21.07,31.15 21.07,29.24 20.74,28.9 20.28,28.9 19.93,28.56 19.93,28.26 19.69,28.01 18.7,28.01 18.21,28.5 18.06,28.5 v1(18.05,28.49)
GPIO15: length 19.2
  Top Layer w0.127: 9.88,27.96 9.88,27.97 9.5,28.35 7.97,28.35 7.56,27.94 7.56,27.28 ; 9.88,27.96 v1(10.05,27.8) ; 9.88,27.96 9.88,27.97
  In1.Cu w0.127: v1(16.82,28.11) 16.82,26.88 16.4,26.46 12.07,26.46 11.9,26.63 11.9,26.82 11.17,27.55 10.3,27.55 v1(10.05,27.8)
  Bottom Layer w0.127: 20.63,31.2 20.63,29.29 20.48,29.14 20.18,29.14 19.67,28.63 19.67,28.53 19.39,28.26 18.86,28.26 18.27,28.85 18.2,28.85 18.16,28.89 17.78,28.89 17,28.11 v1(16.82,28.11)
GPIO16: length 4.1
  Top Layer w0.127: v1(4,28.2) 4,27.39
  Bottom Layer w0.127: 5.12,31.01 5.12,29.65 4,28.53 v1(4,28.2)
GPIO17: length 5.7
  Top Layer w0.127: 3.58,27.74 2.92,28.4 v1(2.57,28.4)
  Bottom Layer w0.127: v1(2.57,28.4) 2.72,28.25 3.37,28.25 4.64,29.52 4.64,31.29
GPIO18: length 11.4
  Top Layer w0.127: 2.66,26.26 2.66,26.89 2.56,26.99 v1(2.5,26.99)
  In1.Cu w0.127: v1(8.12,32.39) 8.07,32.34 8.07,29.58 5.46,26.98 5.45,26.99 v1(2.5,26.99)
  Bottom Layer w0.127: 8.1,31.33 8.12,31.35 v1(8.12,32.39)
GPIO19: length 12.9
  Top Layer w0.127: 2.71,25.91 2.05,25.91 1.85,26.1 1.85,26.88 2.09,27.12 2.09,27.39 v1(2.23,27.53)
  In1.Cu w0.127: v1(7.61,32.32) 7.54,32.25 7.54,29.97 7.41,29.84 6.97,29.84 6.69,29.56 6.69,28.57 5.65,27.53 v1(2.23,27.53)
  Bottom Layer w0.127: v1(7.61,32.32) 7.61,31.26
